# EasyEDA Pro project 智能车.eprj, schematic 4路有刷驱动

## Sheets
1 P1: Create Date: 2024-03-17; Page Name: P1; Project Name: 智能车; Schematic Name: Schematic3; Update Date: 2024-03-18; Company: 嘉立创EDA; Page Size: A4; Version: V1.0
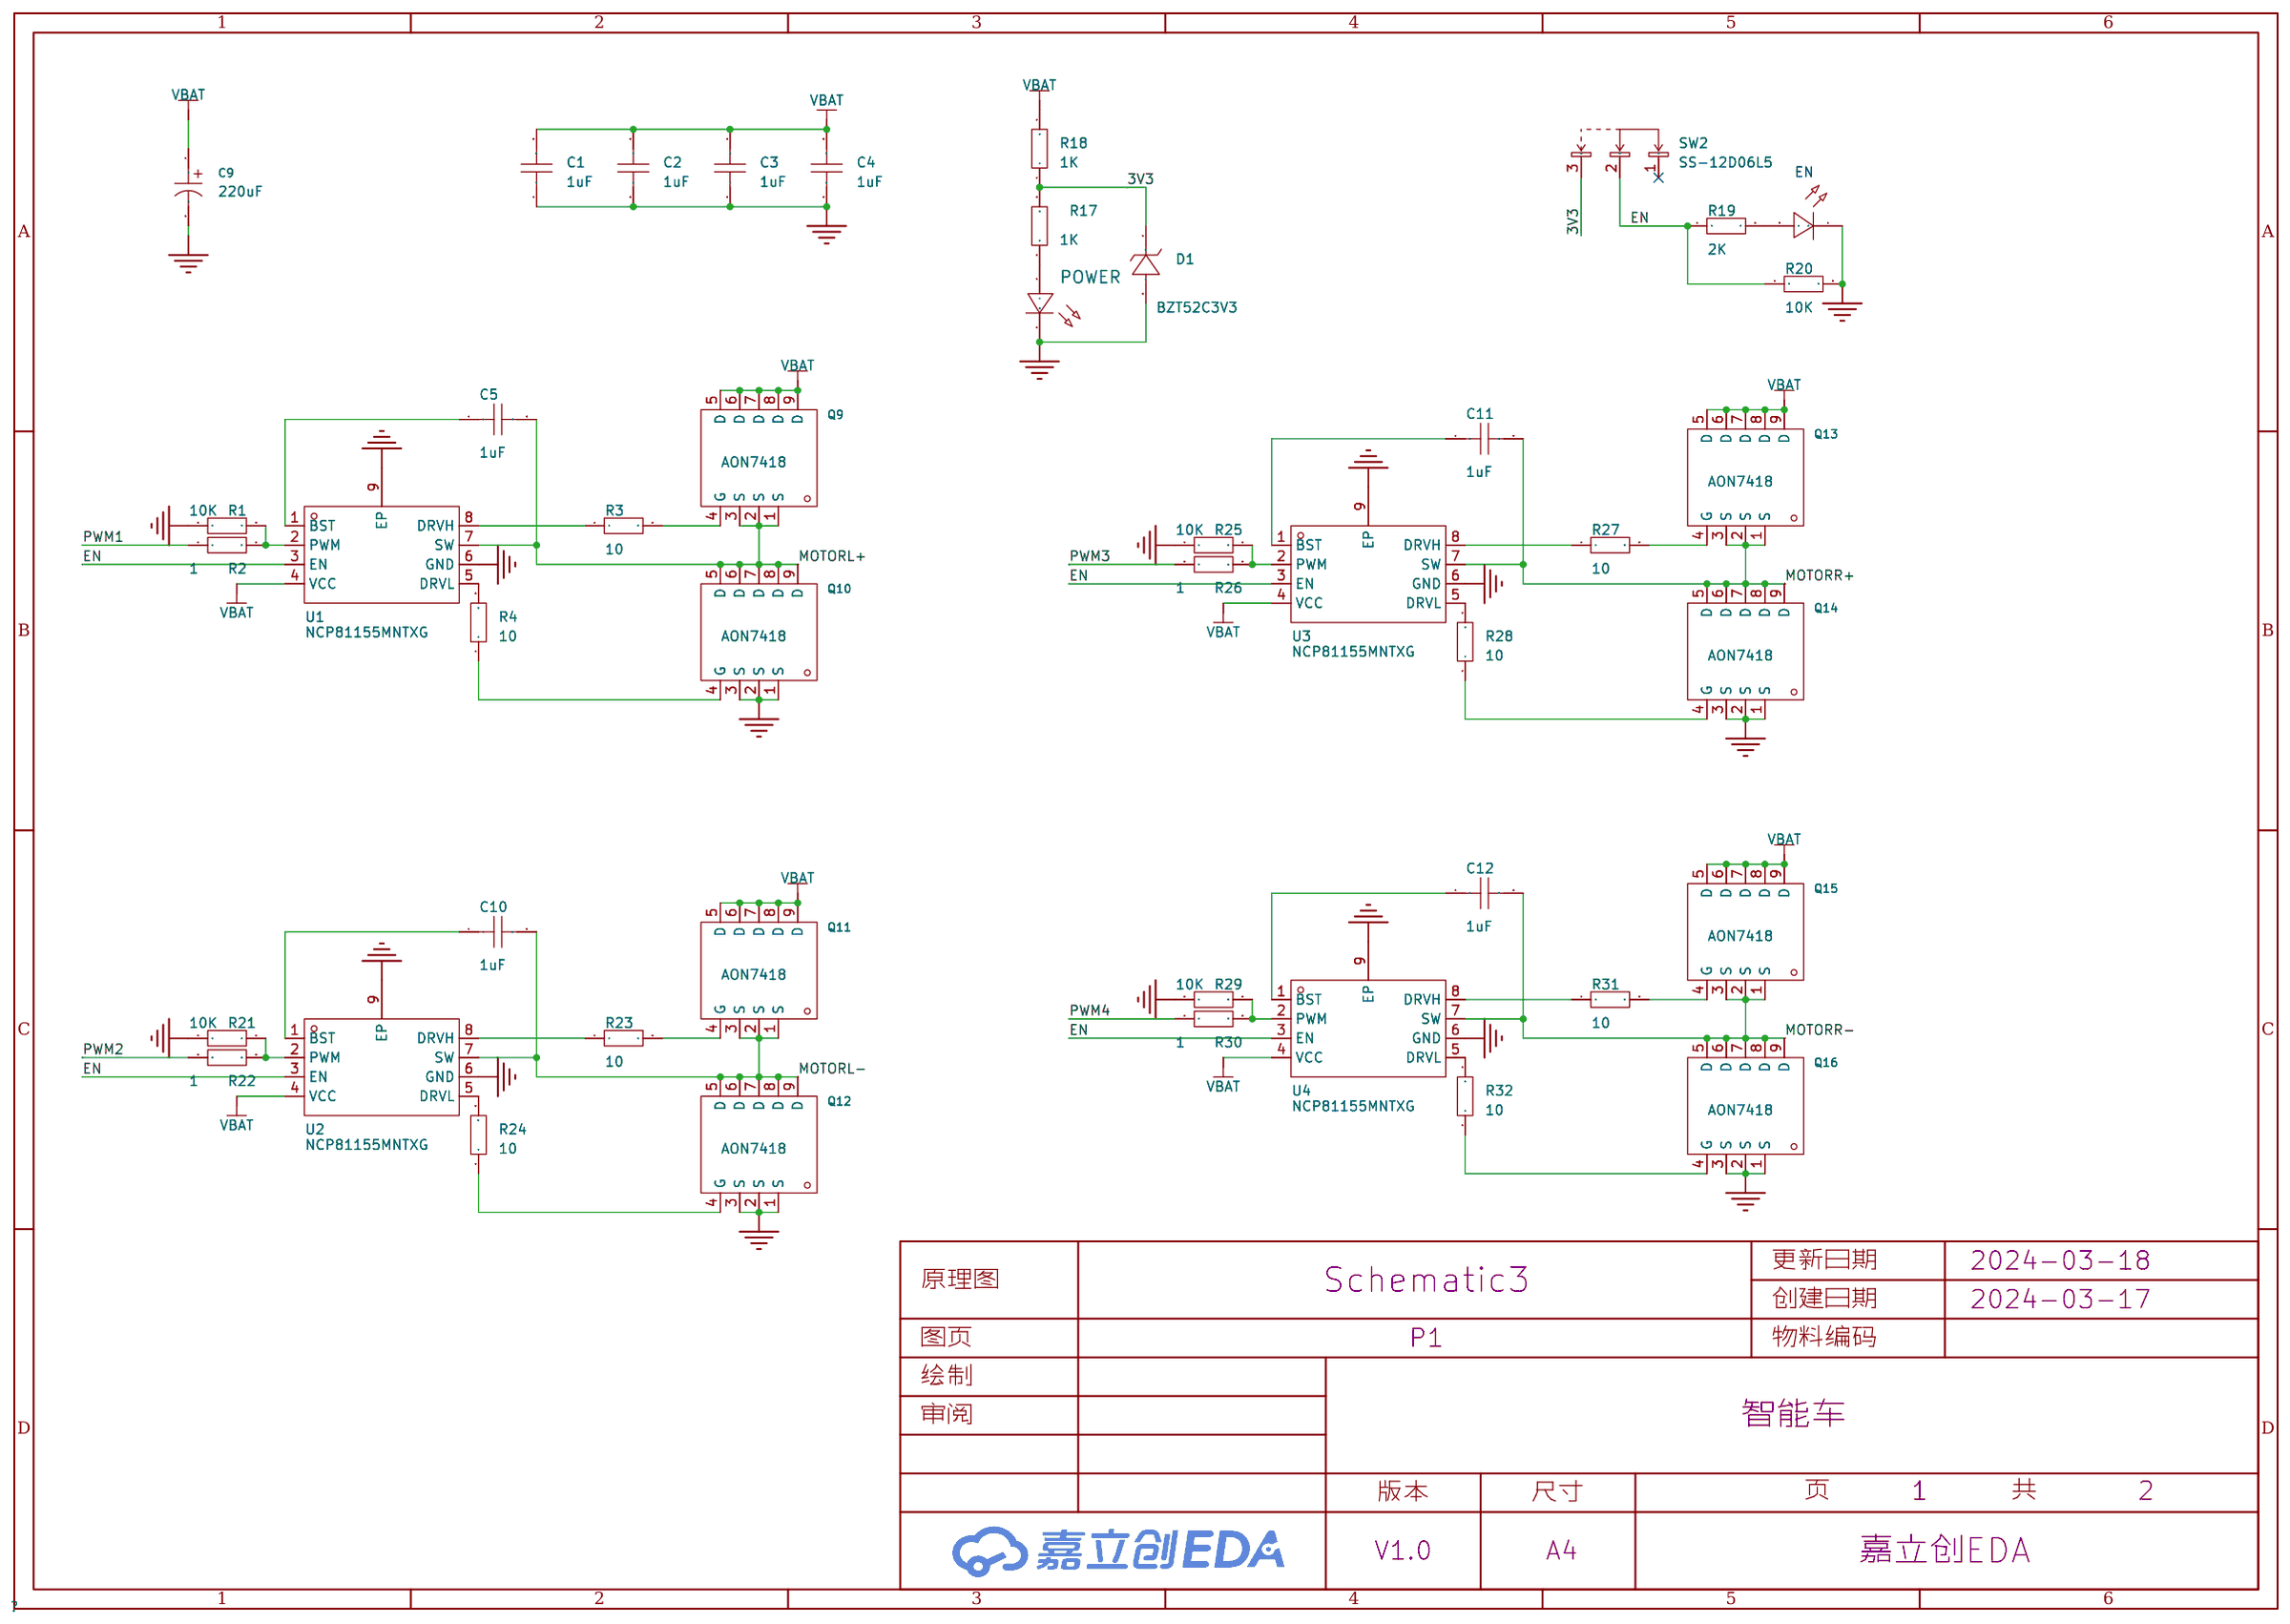
[diagram p6: P1]
2 P2: Page Name: P2; Update Date: 2024-03-17
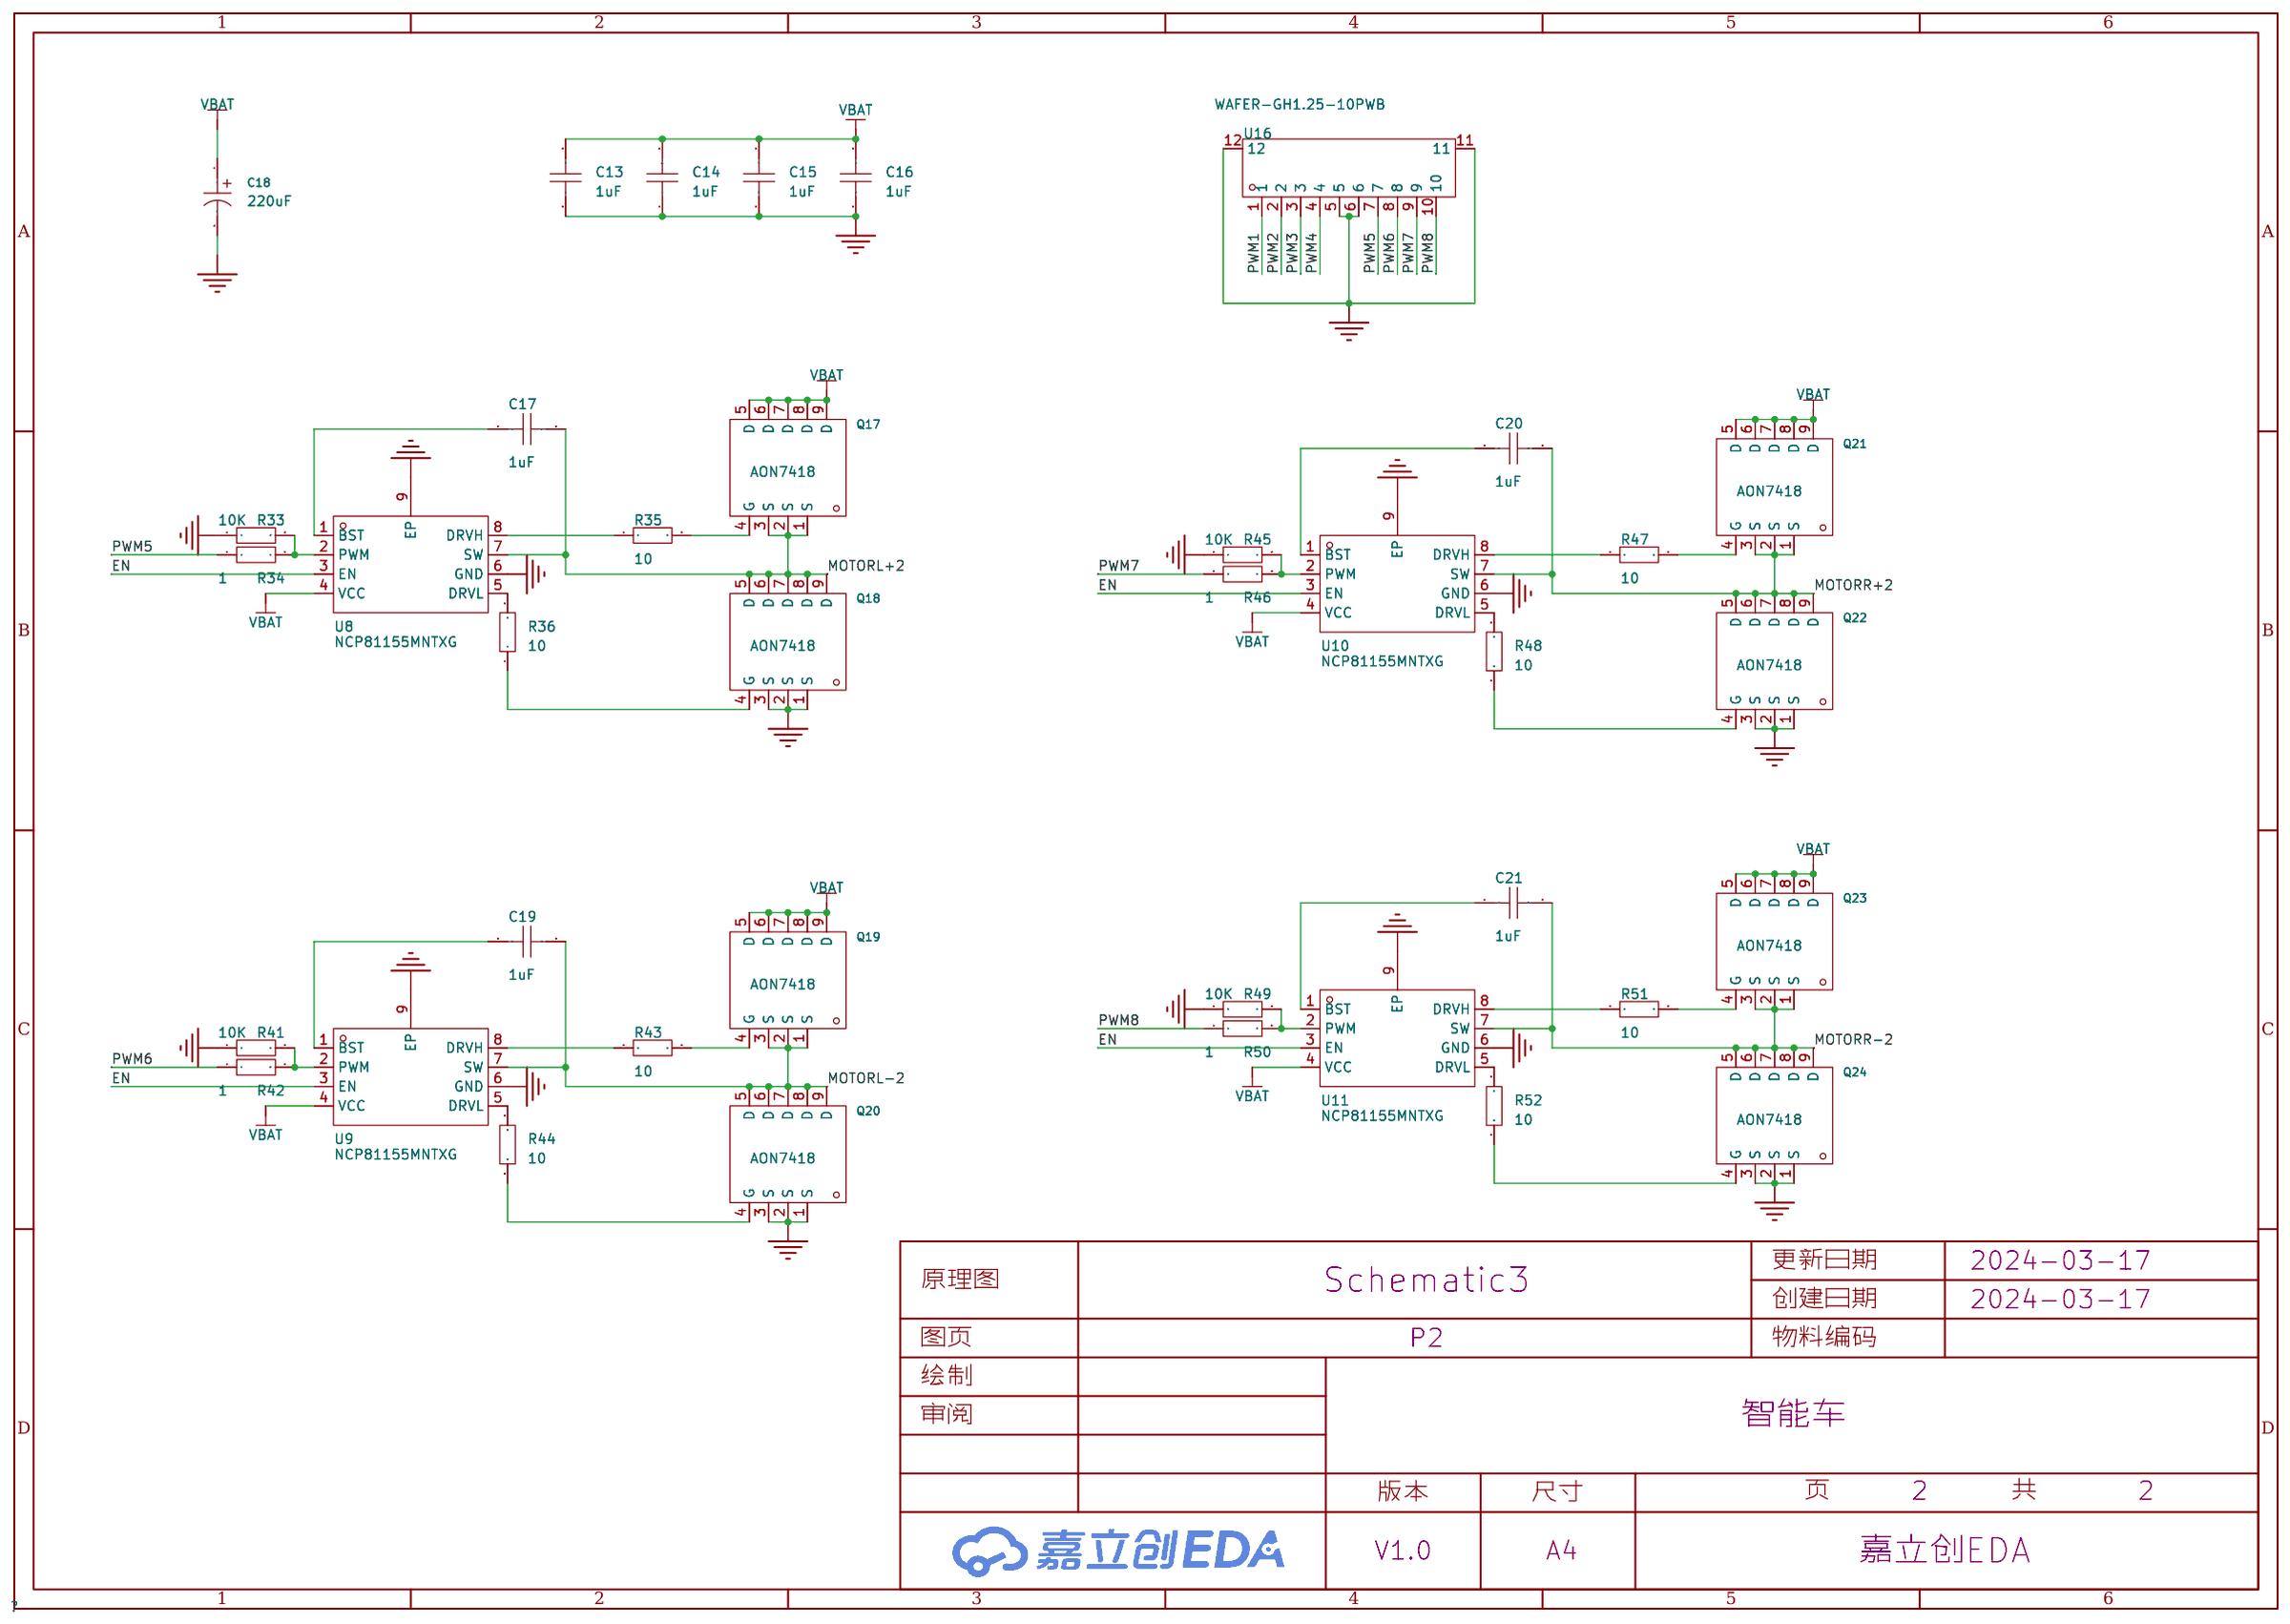
[diagram p7: P2]

## Parts
sheet P1
C1  1uF  [C0402]
C2  1uF  [C0402]
C3  1uF  [C0402]
C4  1uF  [C0402]
C5  1uF  [C0402]
C9  220uF  [CAP-SMD_BD8.0-L8.3-W8.3-LS9.3-FD]
C10  1uF  [C0402]
C11  1uF  [C0402]
C12  1uF  [C0402]
D1  BZT52C3V3  [SOD-123_L2.7-W1.7-LS3.8-RD]
EN  -  [LED_0603]
POWER  -  [LED_0603]
Q9  AON7418  [PDFN-8_L3.3-W3.3-P0.65-BL]
Q10  AON7418  [PDFN-8_L3.3-W3.3-P0.65-BL]
Q11  AON7418  [PDFN-8_L3.3-W3.3-P0.65-BL]
Q12  AON7418  [PDFN-8_L3.3-W3.3-P0.65-BL]
Q13  AON7418  [PDFN-8_L3.3-W3.3-P0.65-BL]
Q14  AON7418  [PDFN-8_L3.3-W3.3-P0.65-BL]
Q15  AON7418  [PDFN-8_L3.3-W3.3-P0.65-BL]
Q16  AON7418  [PDFN-8_L3.3-W3.3-P0.65-BL]
R1  10K  [R0402]
R2  1  [R0402]
R3  10  [R0402]
R4  10  [R0402]
R17  1K  [R0402]
R18  1K  [R0402]
R19  2K  [R0402]
R20  10K  [R0402]
R21  10K  [R0402]
R22  1  [R0402]
R23  10  [R0402]
R24  10  [R0402]
R25  10K  [R0402]
R26  1  [R0402]
R27  10  [R0402]
R28  10  [R0402]
R29  10K  [R0402]
R30  1  [R0402]
R31  10  [R0402]
R32  10  [R0402]
SW2  SS-12D06L5  [SW-TH_3P-P4.70_L11.1-W12.7]
U1  NCP81155MNTXG  [DFN-8_L3.0-W3.0-P0.50-TL-EP]
U2  NCP81155MNTXG  [DFN-8_L3.0-W3.0-P0.50-TL-EP]
U3  NCP81155MNTXG  [DFN-8_L3.0-W3.0-P0.50-TL-EP]
U4  NCP81155MNTXG  [DFN-8_L3.0-W3.0-P0.50-TL-EP]
sheet P2
C13  1uF  [C0402]
C14  1uF  [C0402]
C15  1uF  [C0402]
C16  1uF  [C0402]
C17  1uF  [C0402]
C18  220uF  [CAP-SMD_BD8.0-L8.3-W8.3-LS9.3-FD]
C19  1uF  [C0402]
C20  1uF  [C0402]
C21  1uF  [C0402]
Q17  AON7418  [PDFN-8_L3.3-W3.3-P0.65-BL]
Q18  AON7418  [PDFN-8_L3.3-W3.3-P0.65-BL]
Q19  AON7418  [PDFN-8_L3.3-W3.3-P0.65-BL]
Q20  AON7418  [PDFN-8_L3.3-W3.3-P0.65-BL]
Q21  AON7418  [PDFN-8_L3.3-W3.3-P0.65-BL]
Q22  AON7418  [PDFN-8_L3.3-W3.3-P0.65-BL]
Q23  AON7418  [PDFN-8_L3.3-W3.3-P0.65-BL]
Q24  AON7418  [PDFN-8_L3.3-W3.3-P0.65-BL]
R33  10K  [R0402]
R34  1  [R0402]
R35  10  [R0402]
R36  10  [R0402]
R41  10K  [R0402]
R42  1  [R0402]
R43  10  [R0402]
R44  10  [R0402]
R45  10K  [R0402]
R46  1  [R0402]
R47  10  [R0402]
R48  10  [R0402]
R49  10K  [R0402]
R50  1  [R0402]
R51  10  [R0402]
R52  10  [R0402]
U8  NCP81155MNTXG  [DFN-8_L3.0-W3.0-P0.50-TL-EP]
U9  NCP81155MNTXG  [DFN-8_L3.0-W3.0-P0.50-TL-EP]
U10  NCP81155MNTXG  [DFN-8_L3.0-W3.0-P0.50-TL-EP]
U11  NCP81155MNTXG  [DFN-8_L3.0-W3.0-P0.50-TL-EP]
U16  WAFER-GH1.25-10PWB  [CONN-SMD_10P-P1.25_XUNPU_WAFER-GH1.25-10PWB]

## Library data of the parts
C1-C5 C10-C17 C19-C21 = CAP_0603: Supplier Footprint: 0603
C9 C18 = RVT220UF35V67RV0024: 容值:220uF;精度:±20%;额定电压:35V;纹波电流:195mA@120Hz;等效串联电阻:-;; LCSC Part Name: 220uF ±20% 35V; Supplier Part: C2836441; Manufacturer: KNSCHA(科尼盛); Supplier Footprint: SMD,D8xL10.2mm; JLCPCB Part Class: Extended Part; Datasheet: https://atta.szlcsc.com/upload/public/pdf/source/20210528/C2836441_17B1F737CDEB8BC64E6C288AF923F1CC.pdf; Supplier: LCSC; Tolerance: ±20%; Rated Voltage: 35V; φD: 8mm; L: 10.2mm; Ripple Current: 195mA@120Hz; Lifetime @ Temp: 2000hrs@105℃; Operating Temperature: -55℃~+105℃
D1 = BZT52C3V3_C726990: 稳压值(标称值):3.3V;精度:-;功率:500mW;反向电流(Ir):5uA@1V;; LCSC Part Name: 3.3V 500mW; Supplier Part: C726990; Manufacturer: TWGMC(台湾迪嘉); Supplier Footprint: SOD-123; JLCPCB Part Class: Extended Part; Datasheet: https://atta.szlcsc.com/upload/public/pdf/source/20200825/C726987_AA6CB64B7861C942BF0EE5963BB1FA70.pdf; Supplier: LCSC; Zener Voltage (Nom): 3.3V; Power Dissipation: 500mW; Reverse Leakage Current (Ir): 5uA@1V
EN = LED_0603-G: Supplier Footprint: 0603
POWER = LED_0603-R: Supplier Footprint: 0603
Q9-Q24 = AON7418: 类型:N沟道;漏源电压(Vdss):30V;连续漏极电流(Id):46A;功率(Pd):6.2W;导通电阻(RDS(on)@Vgs,Id):1.7mΩ@10V,20A;; LCSC Part Name: N沟道 耐压:30V 电流:46A; Supplier Part: C74384; Manufacturer: AOS; Supplier Footprint: DFN-8(3x3); JLCPCB Part Class: 扩展库; Datasheet: https://atta.szlcsc.com/upload/public/pdf/source/20190807/C74384_449E04F421CDCCDE17205D9B23C0216A.pdf; Supplier: LCSC; Type: N沟道; Drain Source Voltage (Vdss): 30V; Continuous Drain Current (Id): 46A; Power Dissipation (Pd): 6.2W; Drain Source On Resistance (RDS(on)@Vgs,Id): 1.7mΩ@10V,20A; Gate Threshold Voltage (Vgs(th)@Id): 2.2V@250uA
R1-R4 R17-R36 R41-R52 = Res_0603: Supplier Footprint: 0603
SW2 = SS-12D06L5: 电路结构:单刀双掷;安装方式:侧插;开关颜色:黑色;额定电流(DC):3A;额定电压(DC):250V;额定电流(AC):3A;额定电压(AC):250V;机械寿命:1万次;; LCSC Part Name: 柄长5mm 卧插双档 滑动开关; Supplier Part: C319015; Manufacturer: XKB Connectivity(中国星坤); Supplier Footprint: 插件; JLCPCB Part Class: Extended Part; Datasheet: https://atta.szlcsc.com/upload/public/pdf/source/20211009/0D67854FD60FB1F6FE75130AD47C052C.pdf; Supplier: LCSC; Circuit: 单刀双掷; Actuator Style: 矩形柱状; Pin Style: PC引脚; Switch Length: 12.95mm; Switch Width: 6.6mm; Switch Height: 6.3mm; Mounting Style: 侧插; Actuator Color: 黑色; Current Rating (DC): 3A; Voltage Rating (DC): 250V; Current Rating (AC): 3A; Voltage Rating (AC): 250V; Mechanical Life: 1万次; Operating Temperature: -40℃~+85℃
U1-U4 U8-U11 = NCP81155MNTXG: 驱动配置:半桥;负载类型:MOSFET;电源电压:4.5V~13.2V;峰值灌电流:-;; Supplier Part: C173765; Manufacturer: onsemi(安森美); Supplier Footprint: DFN-8-EP(3x3); JLCPCB Part Class: 扩展库; Datasheet: https://atta.szlcsc.com/upload/public/pdf/source/20221020/7D519529A85A5CD96CBFD99E86ADE911.pdf; Supplier: LCSC; Driven Configuration: 半桥; Number of Drivers: 2; loadtype: MOSFET; Supply Voltage: 4.5V~13.2V; Rise Time: 16ns; Fall Time: 11ns; Operating Temperature: -40℃~+150℃@(Tj)
U16 = WAFER-GH1.25-10PWB: 插针结构:1x10P;间距:1.25mm;安装方式:卧贴;参考系列:GH;总PIN数:10P;排数:1;每排PIN数:10;额定电流:1A;工作温度范围:-25℃~+85℃;; LCSC Part Name: 1x10P 间距:1.25mm 卧贴 系列:GH; Supplier Part: C3029385; Manufacturer: XUNPU(讯普); Supplier Footprint: SMD,P=1.25mm,卧贴; JLCPCB Part Class: Extended Part; Datasheet: https://atta.szlcsc.com/upload/public/pdf/source/20220527/CB8773BFB0913C3B8ABD62CB38BA101A.pdf; Supplier: LCSC; Pins Structure: 1x10P; Pitch: 1.25mm; Mounting Style: 卧贴; Reference Series: GH; Number of Pins: 10P; Number of Rows: 1; Number of PINs Per Row: 10; Current Rating (Max): 1A; Operating Temperature Range: -25℃~+85℃

## Nets
3V3: D1.1(K) R17.2 R18.1 SW2.3
GND: C1.1 C2.1 C3.1 C4.1 C9.2 C13.1 C14.1 C15.1 C16.1 C18.2 D1.2(A) EN.1(C) POWER.1(C) Q10.1(S) Q10.2(S) Q10.3(S) Q12.1(S) Q12.2(S) Q12.3(S) Q14.1(S) Q14.2(S) Q14.3(S) Q16.1(S) Q16.2(S) Q16.3(S) Q18.1(S) Q18.2(S) Q18.3(S) Q20.1(S) Q20.2(S) Q20.3(S) Q22.1(S) Q22.2(S) Q22.3(S) Q24.1(S) Q24.2(S) Q24.3(S) R1.1 R20.2 R21.1 R25.1 R29.1 R33.1 R41.1 R45.1 R49.1 U1.6(GND) U1.9(EP) U2.6(GND) U2.9(EP) U3.6(GND) U3.9(EP) U4.6(GND) U4.9(EP) U8.6(GND) U8.9(EP) U9.6(GND) U9.9(EP) U10.6(GND) U10.9(EP) U11.6(GND) U11.9(EP) U16.5 U16.6 U16.11 U16.12
VBAT: C1.2 C2.2 C3.2 C4.2 C9.1 C13.2 C14.2 C15.2 C16.2 C18.1 Q9.5(D) Q9.6(D) Q9.7(D) Q9.8(D) Q9.9(D) Q11.5(D) Q11.6(D) Q11.7(D) Q11.8(D) Q11.9(D) Q13.5(D) Q13.6(D) Q13.7(D) Q13.8(D) Q13.9(D) Q15.5(D) Q15.6(D) Q15.7(D) Q15.8(D) Q15.9(D) Q17.5(D) Q17.6(D) Q17.7(D) Q17.8(D) Q17.9(D) Q19.5(D) Q19.6(D) Q19.7(D) Q19.8(D) Q19.9(D) Q21.5(D) Q21.6(D) Q21.7(D) Q21.8(D) Q21.9(D) Q23.5(D) Q23.6(D) Q23.7(D) Q23.8(D) Q23.9(D) R18.2 U1.4(VCC) U2.4(VCC) U3.4(VCC) U4.4(VCC) U8.4(VCC) U9.4(VCC) U10.4(VCC) U11.4(VCC)
EN: R19.1 R20.1 SW2.2 U1.3(EN) U2.3(EN) U3.3(EN) U4.3(EN) U8.3(EN) U9.3(EN) U10.3(EN) U11.3(EN)
MOTORL+: C5.2 Q9.1(S) Q9.2(S) Q9.3(S) Q10.5(D) Q10.6(D) Q10.7(D) Q10.8(D) Q10.9(D) U1.7(SW)
MOTORL+2: C17.2 Q17.1(S) Q17.2(S) Q17.3(S) Q18.5(D) Q18.6(D) Q18.7(D) Q18.8(D) Q18.9(D) U8.7(SW)
MOTORL-: C10.2 Q11.1(S) Q11.2(S) Q11.3(S) Q12.5(D) Q12.6(D) Q12.7(D) Q12.8(D) Q12.9(D) U2.7(SW)
MOTORL-2: C19.2 Q19.1(S) Q19.2(S) Q19.3(S) Q20.5(D) Q20.6(D) Q20.7(D) Q20.8(D) Q20.9(D) U9.7(SW)
MOTORR+: C11.2 Q13.1(S) Q13.2(S) Q13.3(S) Q14.5(D) Q14.6(D) Q14.7(D) Q14.8(D) Q14.9(D) U3.7(SW)
MOTORR+2: C20.2 Q21.1(S) Q21.2(S) Q21.3(S) Q22.5(D) Q22.6(D) Q22.7(D) Q22.8(D) Q22.9(D) U10.7(SW)
MOTORR-: C12.2 Q15.1(S) Q15.2(S) Q15.3(S) Q16.5(D) Q16.6(D) Q16.7(D) Q16.8(D) Q16.9(D) U4.7(SW)
MOTORR-2: C21.2 Q23.1(S) Q23.2(S) Q23.3(S) Q24.5(D) Q24.6(D) Q24.7(D) Q24.8(D) Q24.9(D) U11.7(SW)
PWM1: R2.1 U16.1
PWM2: R22.1 U16.2
PWM3: R26.1 U16.3
PWM4: R30.1 U16.4
PWM5: R34.1 U16.7
PWM6: R42.1 U16.8
PWM7: R46.1 U16.9
PWM8: R50.1 U16.10
$1N2097: R1.2 R2.2 U1.2(PWM)
$1N2098: C5.1 U1.1(BST)
$1N2100: R3.1 U1.8(DRVH)
$1N2101: R4.2 U1.5(DRVL)
$1N2112: POWER.2(A) R17.1
$1N2134: Q9.4(G) R3.2
$1N2137: Q10.4(G) R4.1
$1N2146: R21.2 R22.2 U2.2(PWM)
$1N2147: C10.1 U2.1(BST)
$1N2149: R23.1 U2.8(DRVH)
$1N2150: R24.2 U2.5(DRVL)
$1N2152: Q11.4(G) R23.2
$1N2155: Q12.4(G) R24.1
$1N2164: R25.2 R26.2 U3.2(PWM)
$1N2165: C11.1 U3.1(BST)
$1N2167: R27.1 U3.8(DRVH)
$1N2168: R28.2 U3.5(DRVL)
$1N2170: Q13.4(G) R27.2
$1N2173: Q14.4(G) R28.1
$1N2182: R29.2 R30.2 U4.2(PWM)
$1N2183: C12.1 U4.1(BST)
$1N2185: R31.1 U4.8(DRVH)
$1N2186: R32.2 U4.5(DRVL)
$1N2188: Q15.4(G) R31.2
$1N2191: Q16.4(G) R32.1
$2N2097: R33.2 R34.2 U8.2(PWM)
$2N2098: C17.1 U8.1(BST)
$2N2100: R35.1 U8.8(DRVH)
$2N2101: R36.2 U8.5(DRVL)
$2N2134: Q17.4(G) R35.2
$2N2137: Q18.4(G) R36.1
$2N2146: R41.2 R42.2 U9.2(PWM)
$2N2147: C19.1 U9.1(BST)
$2N2149: R43.1 U9.8(DRVH)
$2N2150: R44.2 U9.5(DRVL)
$2N2152: Q19.4(G) R43.2
$2N2155: Q20.4(G) R44.1
$2N2164: R45.2 R46.2 U10.2(PWM)
$2N2165: C20.1 U10.1(BST)
$2N2167: R47.1 U10.8(DRVH)
$2N2168: R48.2 U10.5(DRVL)
$2N2170: Q21.4(G) R47.2
$2N2173: Q22.4(G) R48.1
$2N2182: R49.2 R50.2 U11.2(PWM)
$2N2183: C21.1 U11.1(BST)
$2N2185: R51.1 U11.8(DRVH)
$2N2186: R52.2 U11.5(DRVL)
$2N2188: Q23.4(G) R51.2
$2N2191: Q24.4(G) R52.1
Net-(EN-2): EN.2(A) R19.2

Not connected (* = marked no-connect by the designer): SW2 1*
